# EasyEDA Pro project STM32G303的双FOC电机驱动.eprj, board axdr_v1.2 (continued)
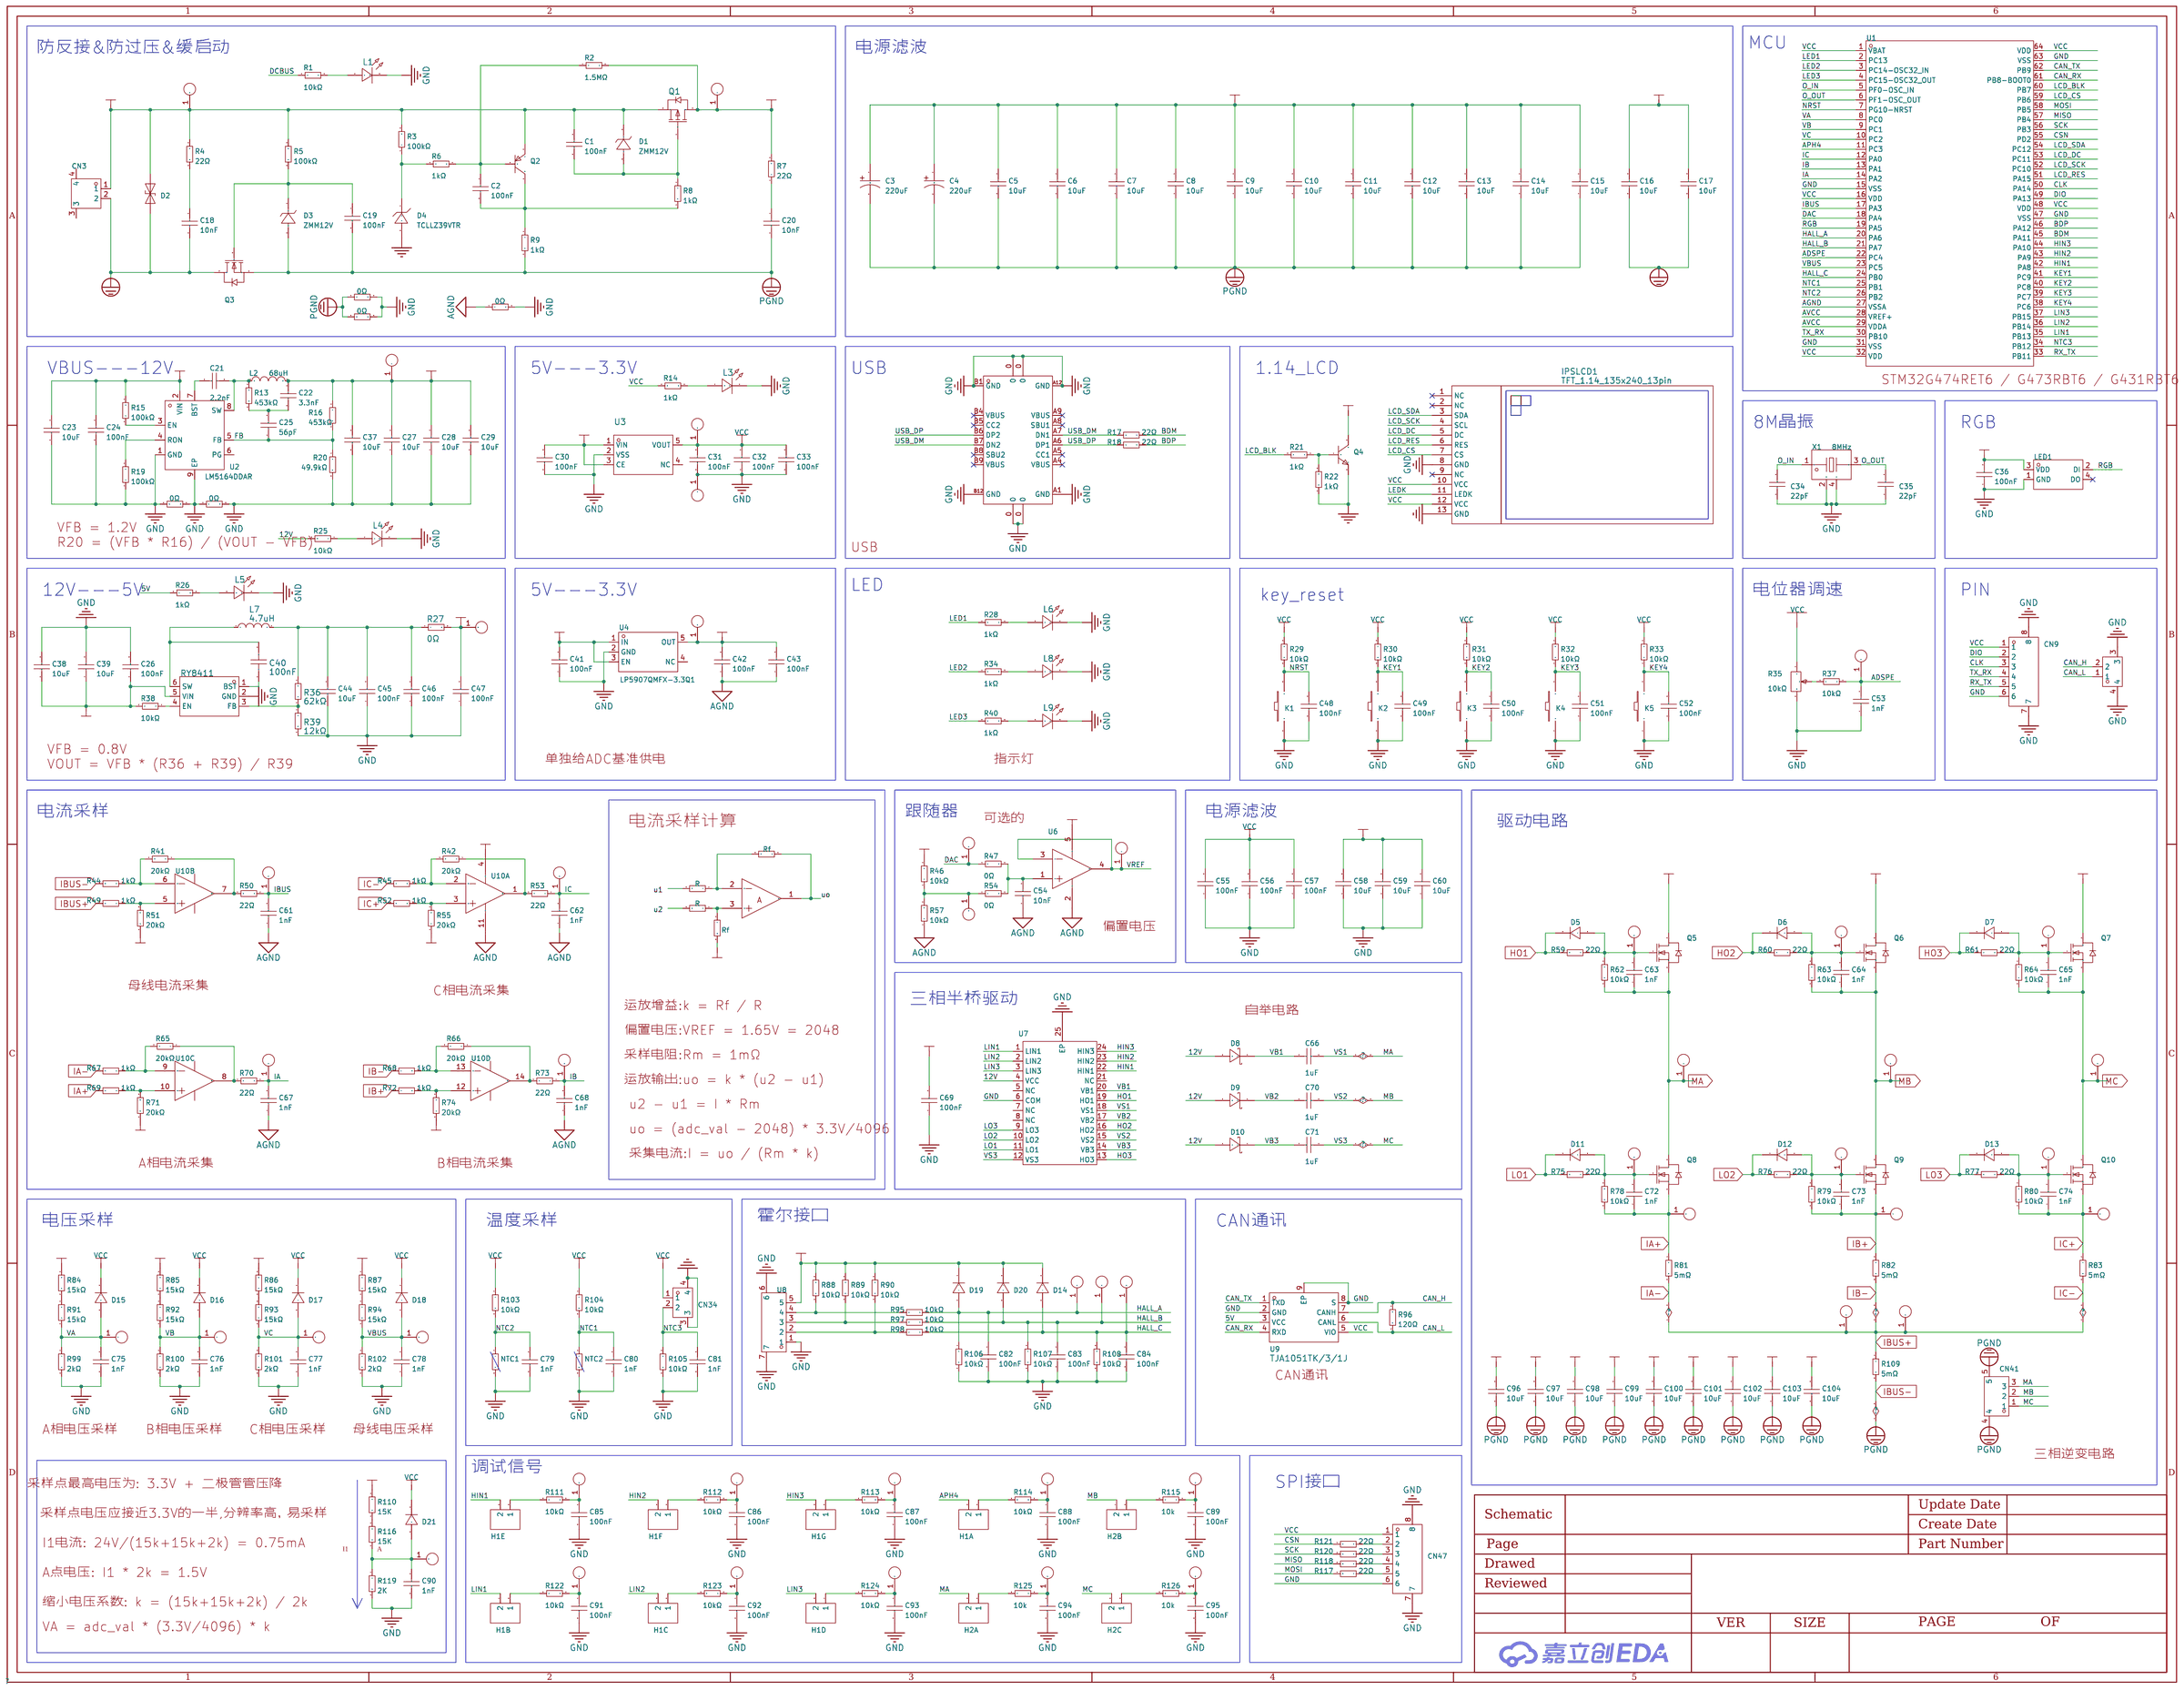
[diagram p0: schematic sheet]
## Routing (per net, layer and track width the routed paths; a pad name or vN(x,y) marks a point on that pad's centre or on a via; arc(x,y) is an arc through that point) (continued)
  内层4 w0.127: v1(71.21,23.83) 70.57,23.2 68.86,23.2 67.93,22.26 67.93,14.43 65.01,11.51 54.47,11.51 53.84,12.15 53.84,15.45 52.95,16.34 52.28,16.34 v1(52.28,16.33)
VB: length 47.6
  Top Layer w0.127: 77.86,27.9 77.57,27.61 77.57,26.5 77.57,26.5 v1(77.57,23.98) ; 77.86,27.9 79.4,27.9 CN38.1 ; 77.86,27.9 77.57,28.19 77.57,29.3 ; U1.9 v1(52.69,15.83)
  内层4 w0.127: v1(52.69,15.83) 53.01,15.83 53.52,15.32 53.52,12.02 54.28,11.26 65.12,11.26 68.19,14.33 68.19,22.16 68.97,22.94 76.82,22.94 77.57,23.69 v1(77.57,23.98)
VB1: length 5.2
  Top Layer w0.152: 44.18,28.66 44.69,28.15 44.69,26.63 45.08,26.23 U7.20
  Top Layer w0.254: C66.2 43.88,28.94 D8.1
VB2: length 8
  Top Layer w0.152: U7.17 47.06,28.2 46.72,28.53 45.92,28.53 45.26,29.19 45.26,31.39 44.99,31.66 D9.1
  Top Layer w0.254: D9.1 43.88,31.96 C70.2
VB3: length 12.3
  Top Layer w0.152: D10.1 45.4,34.68 45.96,34.12 45.96,29.67 46.41,29.23 47.93,29.23 48.56,28.6 U7.14
  Top Layer w0.254: D10.1 43.88,34.98 C71.2
VC: length 52.6
  Top Layer w0.127: 82.94,27.89 82.65,28.18 82.65,29.29 ; 82.94,27.89 82.65,27.6 82.65,26.36 ; 82.94,27.89 84.45,27.89 CN39.1 ; U1.10 v1(52.28,15.33) ; 82.65,26.36 82.65,26.37 ; 82.65,26.36 v1(82.65,23.84)
  内层4 w0.127: v1(82.65,23.84) 78.1,23.84 76.95,22.69 69.08,22.69 68.44,22.05 68.44,14.22 65.22,11 54.03,11 53.26,11.77 53.26,15.07 53.01,15.32 52.29,15.32 v1(52.28,15.33)
VREF: length 61.2
  Top Layer w0.127: CN13.1 65.07,0.97 65.84,1.73 65.84,4.84 65.3,5.39 U6.3
  Top Layer w0.203: R71.1 v1(82.16,20.59) ; R74.1 70.09,23.38 v1(70.09,23.83) ; v1(64.12,8.02) 63.44,8.02 U6.4 U6.3 ; R51.1 77.26,10.99 v1(77.39,10.86) ; 67.31,14.31 67.31,12.65 v1(67.42,12.53)
  Inner2 w0.203: v1(67.42,12.53) 67.81,12.15 76.95,12.15 77.39,11.71 v1(77.39,10.86)
  内层3 w0.203: v1(70.09,23.83) 70.09,22.43 70.73,21.8 78.73,21.8 79.93,20.59 80.89,20.59 ; v1(77.39,10.86) 80.62,10.86 80.89,11.13 80.89,20.59 ; v1(67.42,12.53) 67.11,12.53 65.14,10.56 65.14,8.46 64.69,8.02 v1(64.12,8.02) ; v1(82.16,20.59) 80.89,20.59
$1N7256: length 1.5
  Top Layer w0.254: C18.1 19.3,44.22
$1N10553: length 4
  Top Layer w0.254: Q2.1 21.02,51.39 C2.1 19.92,51.4 17.39,51.4
$1N11589: length 4.9
  Top Layer w0.254: R5.1 23.85,42.87 D3.1 23.48,42.75 21.8,42.75
  Bottom Layer w0.152: C19.1 v1(23.86,44.22)
$1N11866: length 3.8
  Top Layer w0.254: R6.2 17.38,52.91 16.11,52.91 ; 16.11,52.91 R3.1 ; 16.11,52.91 14.85,52.91 14.49,53.27 14.49,54.06
$1N12961: length 1.3
  Top Layer w0.254: C20.1 R7.1
$1N15998: length 8.7
  Top Layer w0.254: R9.1 27.04,52.66 25.78,51.4 25.77,51.4 25.02,52.15 23.21,52.15 Q2.3 21.96,52.9 C2.2
$1N55849: length 28.3
  Top Layer w0.254: CN17.1 59.42,48.34 57.01,48.34 ; 56.38,49.88 55.24,49.88 54.72,49.36 54.72,33.99 54.09,33.36 49.56,33.36 48.06,31.85 R59.1
$1N56388: length 36.1
  Top Layer w0.254: 55.74,27.63 56.99,27.63 57.76,28.4 59.04,28.4 60.06,29.42 60.06,32.47 60.82,33.23 67.23,33.23 67.81,33.8 67.81,49.23 68.45,49.88 69.46,49.88 ; Q8.1 72.38,48.34 CN25.1
$1N57486: length 18.5
  Top Layer w0.254: CN18.1 59.42,41.35 57.01,41.35 ; R63.1 55.62,42.89 55.23,42.5 55.23,33.86 54.22,32.85 52.13,32.85 51.13,31.85 49.9,31.85
$1N57488: length 27.1
  Top Layer w0.254: CN26.1 72.38,41.35 70.09,41.35 ; R76.1 60.02,27.5 D12.2 60.57,28.05 60.57,32.21 61.07,32.72 67.55,32.72 68.31,33.48 68.31,42.64 68.57,42.89 R79.1
$1N58344: length 8.6
  Top Layer w0.203: D7.2 54.11,31.85 52.88,31.85
  Top Layer w0.254: R64.1 56.38,34.12 D7.2 ; CN19.1 59.42,34.37 57.01,34.37
$1N58346: length 14.6
  Top Layer w0.254: CN27.1 72.38,34.37 Q10.1 70.09,34.36 v1(70.09,33.23) ; R77.1 63.07,27.5 D13.2 v1(63.36,28.28)
  Inner2 w0.254: v1(70.09,33.23) 70.09,32.72 65.65,28.28 v1(63.36,28.28)
$1N74659: length 5.9
  Top Layer w0.127: R55.2 R52.2 69.33,15.58 69.58,15.83 69.58,17.61 69.98,18 71.36,18
$1N75153: length 4
  Top Layer w0.127: U10.2 69.35,18.66 R42.2 R45.2
$1N75339: length 4.6
  Top Layer w0.127: U10.1 71.28,19.39 R53.2 67.53,18.12 67.31,18.12
$1N78360: length 4.4
  Top Layer w0.127: R41.1 73.45,12.51 72.31,13.65 ; R50.2 72.18,15.2 71.98,15.4 U10.7
$1N78363: length 8
  Top Layer w0.127: U10.5 74.42,16.7 75.17,15.96 75.17,14.56 75.99,13.74 R49.2 R51.2
$1N78364: length 6.6
  Top Layer w0.127: 71.36,16.05 74.25,16.05 74.72,15.58 R44.2 74.72,13.65 73.58,13.65
$1N79721: length 4.6
  Top Layer w0.127: 76.96,19.3 76.25,19.3 76,19.55 R73.2 74.72,22.32 R66.1
$1N79723: length 7.8
  Top Layer w0.127: 76.96,18 75.79,18 74.28,19.51 72.89,19.51 72.19,20.21 R72.2 R74.2
$1N79724: length 5.4
  Top Layer w0.127: 76.96,18.66 76.93,18.62 75.68,18.62 74.72,19.58 R66.2 R68.2
$1N80505: length 4.5
  Top Layer w0.127: 76.96,15.4 79.26,15.4 R70.2 80.64,16.78 R65.1
$1N80507: length 6
  Top Layer w0.127: R71.2 R69.2 78.66,19.32 78.35,19.01 78.35,16.97 78.08,16.7 76.96,16.7
$1N80508: length 4
  Top Layer w0.127: 76.96,16.05 78.64,16.05 R65.2 R67.2
$1N96819: length 2
  Top Layer w0.127: 71.12,29.31 72.39,30.57 R84.2
$1N96824: length 2
  Top Layer w0.127: R85.2 77.34,30.57 76.07,29.3
$1N96829: length 2
  Top Layer w0.127: 67.67,30.56 67.42,30.56 66.16,29.3 66.16,29.29
$1N96834: length 2
  Top Layer w0.127: 82.65,30.56 82.42,30.56 81.15,29.29
$1N107842: length 7.8
  Top Layer w0.127: R95.1 89.33,18.11 R88.2 91.83,15.61 U8.4
$1N108105: length 7.1
  Top Layer w0.127: 94.81,14.36 91.88,14.36 91.05,15.2 89.34,15.2 R89.2 88.07,15.19 R97.1
$1N108370: length 7.1
  Top Layer w0.127: R90.2 91.04,12.27 91.88,13.11 U8.2 ; 89.33,12.26 R98.1
$1N130103: length 1.3
  Top Layer w0.254: R40.1 36.57,36.37 35.31,36.37
$1N130414: length 3.8
  内层3 w0.254: v1(34.04,36.37) 37.84,36.37 v1(37.85,36.36)
$1N134680: length 1.3
  Top Layer w0.254: L5.1 12.31,11.64
$1N145652: length 7
  Top Layer w0.127: CN47.5 94.78,26.88 R117.1
$1N145656: length 7
  Top Layer w0.127: R118.1 87.86,25.6 CN47.4
$1N145660: length 7
  Top Layer w0.127: CN47.3 87.86,24.35 R120.1
$1N145664: length 7
  Top Layer w0.127: CN47.2 87.88,23.1 R121.1
$1N245778: length 2.7
  Top Layer w0.254: U5.3 17.49,28.34 R36.2 R39.1
$1N245779: length 3.6
  Top Layer w0.203: L7.1 12.67,30.57 C40.2 13.5,30.49 U5.6
$1N245780: length 1.7
  Top Layer w0.203: C40.1 13.5,28.98 U5.1
$1N268846: length 1.3
  Top Layer w0.127: 5.58,21.8 5.58,23.07
$1N269486: length 2.3
  Top Layer w0.152: 39.12,31.21 39.12,31.44 37.85,32.71 37.85,33.02
$1N270139: length 2.8
  Top Layer w0.127: 77.52,2.51 77.52,2.5 CN42.1 ; 77.52,2.51 C85.1 ; 77.52,2.51 R111.1
$1N270143: length 2.4
  Top Layer w0.127: 77.52,6.18 77.52,4.63 R111.2
$1N270253: length 2.8
  Top Layer w0.127: 70.56,2.5 70.55,2.51 69.91,2.51 ; CN49.1 69.91,0.98 69.91,2.51 ; 69.91,2.51 R122.1
$1N270255: length 2.4
  Top Layer w0.127: R122.2 69.9,4.63 69.9,6.18
$1N270473: length 2.8
  Top Layer w0.127: 80.07,2.51 80.06,2.49 CN43.1 ; 80.07,2.51 R112.1 ; 80.07,2.51 C86.1
$1N270475: length 2.4
  Top Layer w0.127: R112.2 80.06,4.63 80.06,6.18
$1N270480: length 2.8
  Top Layer w0.127: R123.1 C92.1 ; CN50.1 72.44,2.5
$1N270482: length 2.4
  Top Layer w0.127: R123.2 72.44,4.63 72.44,6.18
$1N270701: length 2.8
  Top Layer w0.127: 82.6,2.51 82.6,2.5 CN44.1 ; 82.6,2.51 R113.1 ; 82.6,2.51 C87.1
$1N270703: length 2.4
  Top Layer w0.127: R113.2 82.6,4.63 82.6,6.18
$1N270708: length 2.8
  Top Layer w0.127: R124.1 74.97,2.51 ; 74.97,2.51 C93.1 ; 74.97,2.51 74.98,2.5 CN51.1
$1N270710: length 2.4
  Top Layer w0.127: R124.2 74.98,4.63 74.98,6.18
$1N398404: length 17.4
  Top Layer w0.254: Q1.1 16.75,45.68 v1(16.62,45.8) ; 25.77,52.91 25.76,52.9 C1.2 24.48,52.91 v1(23.48,52.91)
  Inner2 w0.254: v1(16.62,45.8) 16.62,49.87 17.13,50.37 22.97,50.37 23.48,50.88 v1(23.48,52.91)
$1N441583: length 2.8
  Top Layer w0.127: 67.35,2.51 C88.1 ; 67.35,2.51 R114.1 ; 67.35,2.51 67.36,2.5 67.36,0.97
$1N441584: length 2.4
  Top Layer w0.127: 67.36,6.18 67.36,4.63 R114.2
$1N704042: length 6.8
  内层3 w0.254: v1(39.12,36.36) 38.52,35.77 33.36,35.77 v1(32.77,36.37)
$1N752227: length 6.1
  Top Layer w0.127: R54.1 61.19,1.62 61.84,0.97 CN16.1 63.04,0.97 63.74,1.67 63.74,2.49 R57.2
  Top Layer w0.152: 65,2.5 R57.2
$1N807322: length 6.8
  Top Layer w0.152: R35.2 92.25,7.7 93.33,6.62 95.73,6.62 R37.2
$1N846235: length 2.1
  Top Layer w0.203: U5.4 16.05,31.38 16.31,31.64 17,31.64 17.53,32.17
$1N858763: length 4.3
  Top Layer w0.127: U6.1 61.51,5.17 62.46,4.22 C54.2 R54.2 R47.2
$1N920711: length 3.3
  Top Layer w0.127: R21.1 47.42,8.09 Q4.1 47.19,9.61 R22.1
$1N958663: length 15.9
  Top Layer w0.254: v1(17.53,25.67) R36.1
  Top Layer w0.508: R27.1 8.95,30.61 v1(8.94,30.61)
  Inner2 w0.254: v1(17.53,25.67) 16.95,25.1 v1(14.02,25.1)
  内层3 w0.508: v1(14.02,25.1) v1(13.39,25.1) 11.61,25.1 8.94,27.77 v1(8.94,30.61) v1(8.94,31.2)
$1N1062496: length 1.3
  Top Layer w0.203: 16.26,36.37 17.53,36.37
$1N1062500: length 2.1
  Top Layer w0.254: 34.75,31.13 34.75,32.45 R19.1
$1N1062505: length 2.6
  Top Layer w0.203: C25.2 C22.2 R13.2
$1N1062507: length 4.1
  Top Layer w0.254: R15.2 35.74,32.18 35.74,30.49 35.11,29.86 34.75,29.86
$1N1062508: length 1.7
  Top Layer w0.508: U2.7 27.23,28.59 C21.1

## Copper pours and planes (outline as drawn; the poured copper is in the pictures)
12V on Top Layer: 14.78,30.63 14.85,30.56 15.35,30.56 15.42,30.63 15.42,31.83 15.54,31.96 16.62,31.96 16.69,32.02 16.69,32.85 16.81,32.98 18.59,32.98 18.72,32.85 18.72,31.45 24.69,31.45 24.69,34.31 24.75,34.37 28.12,34.37 28.18,34.44 28.18,35.26 28.12,35.33 17.13,35.33 17.01,35.2 17.01,34.18 16.88,34.05 15.86,34.05 15.75,33.94 15.75,33.04 14.78,32.07
AGND on 内层3: 68.34,21.42 79.87,21.42 79.87,13.29 68.34,13.29
GND on Top Layer: 0,55 0,0 83.81,0 83.81,-2.71 85.08,-2.71 85.08,0 100,0 100,55.02
GND on Bottom Layer: 0,55 0,0 81.05,0 81.05,-2.71 82.69,-2.71 82.69,0 100,0 100,55
GND on Inner1: 0,55 0,0 88.47,0 88.47,-2.71 90.04,-2.71 90.04,0 100,0 100,55
GND on Inner2: 0,55 0,0 91.39,0 91.39,-2.71 92.46,-2.71 92.46,0 100,0 100,55
GND on 内层3: 0,55 0,0 93.29,0 93.29,-2.71 94.36,-2.71 94.36,0 100,0 100,55
GND on 内层4: 0,55 0,0 86.18,0 86.18,-2.71 87.25,-2.71 87.25,0 100,0 100,55
PGND on Top Layer: 29.77,37.99 31.99,37.99 31.99,35.96 29.77,35.96
PGND on Top Layer: 88.25,35.07 88.32,35.01 89.46,35.01 89.52,34.94 89.52,31.45 89.4,31.32 85.01,31.32 84.82,31.13 84.82,29.23 85.08,28.97 92.32,28.97 92.44,29.1 92.44,36.21 93.18,36.95 100,36.95 100,55 83.93,55 83.93,49.1 84.12,48.91 87.95,48.91 88.25,48.61
PGND on Top Layer: 46.98,43.9 46.98,37.29 21.2,37.29 21.2,41.87 24.63,41.87 24.75,41.99 24.75,42.64 26.03,42.64 26.15,42.75 26.15,43.77 26.28,43.9
PGND on Bottom Layer: 88.27,32.72 88.52,32.98 88.52,55.01 92.44,55.01 100,55 100,36.63 92.86,36.63 92.44,36.21 92.44,28.91 42.43,28.93 42.17,29.18 42.17,37.15 42.02,37.29 24.88,37.29 24.63,37.55 24.63,43.77 24.75,43.9 46.98,43.9 46.98,32.98 47.23,32.72 57.31,32.72 57.67,33.09 57.67,53.42 59.42,53.42 59.42,33.1 59.8,32.72
PGND on Inner1: 92.44,28.91 42.43,28.93 42.17,29.18 42.17,37.15 42.02,37.29 24.88,37.29 24.63,37.55 24.63,43.77 24.75,43.9 46.98,43.9 46.98,32.98 47.23,32.72 88.27,32.72 88.52,32.98 88.52,55.01 92.44,55.01 100,55 100,36.63 92.86,36.63 92.44,36.21
PGND on Inner2: 88.26,55 88.26,29.16 88.44,28.97 92.32,28.97 92.44,29.1 92.44,36.21 92.86,36.63 100,36.63 100,55
PGND on 内层3: 92.44,28.91 42.43,28.93 42.17,29.18 42.17,37.15 42.02,37.29 24.88,37.29 24.63,37.55 24.63,43.77 24.75,43.9 46.98,43.9 46.98,32.98 47.23,32.72 88.27,32.72 88.52,32.98 88.52,55.01 92.44,55.01 100,55 100,36.63 92.86,36.63 92.44,36.21
PGND on 内层4: 92.44,28.91 42.43,28.93 42.17,29.18 42.17,37.15 42.02,37.29 24.88,37.29 24.63,37.55 24.63,43.77 24.75,43.9 46.98,43.9 46.98,32.98 47.23,32.72 88.27,32.72 88.52,32.98 88.52,55.01 92.44,55.01 100,55 100,36.63 92.86,36.63 92.44,36.21
PGND_IN on Top Layer: 0.24,43.9 0.37,44.02 15.61,44.02 15.74,44.15 15.74,44.79 16.75,44.79 16.75,43.52 16.88,43.39 20.69,43.39 20.69,38.56 8.12,38.56 7.99,38.69 7.99,39.13 7.92,39.2 0.37,39.2 0.24,39.33
PGND_IN on Bottom Layer: 0.24,43.9 0.37,44.02 15.61,44.02 15.67,43.79 16.78,43.79 16.75,43.52 16.88,43.39 20.69,43.39 20.69,38.56 8.12,38.56 7.99,38.69 7.99,39.13 7.92,39.2 0.37,39.2 0.24,39.33
PGND_IN on Inner1: 0.24,43.89 0.37,44.01 15.35,44.01 15.48,43.89 15.48,39.31 15.35,39.19 0.37,39.19 0.24,39.31
PGND_IN on Inner2: 0.24,43.89 0.37,44.01 15.35,44.01 15.48,43.89 15.48,39.31 15.35,39.19 0.37,39.19 0.24,39.31
PGND_IN on 内层3: 0.24,43.89 0.37,44.01 15.35,44.01 15.48,43.89 15.48,39.31 15.35,39.19 0.37,39.19 0.24,39.31
PGND_IN on 内层4: 0.24,43.89 0.37,44.01 15.35,44.01 15.48,43.89 15.48,39.31 15.35,39.19 0.37,39.19 0.24,39.31
DCBUS on Top Layer: 37.13,29.34 37.06,29.42 36.82,29.42 35.99,28.66 35.99,30.24 36.12,30.37 36.12,31.9 38.35,31.9 38.35,30.87 38.53,30.69 40.75,30.69 40.88,30.56 40.88,28.34 40.82,28.28 37.2,28.28 37.13,28.34
DCBUS on Top Layer: 26.02,45.8 26.15,45.68 26.15,44.78 26.27,44.66 47.42,44.66 47.61,44.44 47.61,33.86 53.45,33.86 53.45,53.42 45.07,53.42 44.95,53.3 44.95,51.26 44.82,51.14 27.93,51.14 27.8,51.01 27.8,50.12 27.67,49.99 19.42,49.99 19.42,45.17 24.37,45.17 24.5,45.29 24.5,45.68 24.63,45.8
DCBUS on Bottom Layer: 26.02,45.17 26.15,45.04 26.15,44.78 26.27,44.66 47.42,44.66 47.61,44.44 47.61,33.86 56.38,33.86 56.38,53.42 45.07,53.42 44.95,53.3 44.95,51.26 44.82,51.14 24.75,51.14 24.63,51.01 24.63,50.18 24.43,49.99 19.42,49.99 19.42,45.17
DCBUS on Inner1: 24.75,51.14 24.63,51.01 24.63,44.79 24.75,44.66 47.36,44.66 47.61,44.4 47.61,33.86 53.45,33.86 53.45,53.42 47.62,53.42 47.62,51.27 47.49,51.14
DCBUS on Inner2: 33.39,51.14 44.63,51.14 44.82,50.95 44.82,44.91 44.56,44.66 42.34,44.66 42.02,44.34 42.02,37.48 41.01,36.47 41.01,28.47 40.82,28.28 36.31,28.28 36.12,28.47 36.12,33.8 36.44,34.12 39.48,34.12 39.61,34.25 39.61,44.28 39.23,44.66 33.52,44.66 33.2,44.98 33.2,50.95
DCBUS on 内层3: 24.75,51.14 24.63,51.01 24.63,44.79 24.75,44.66 47.36,44.66 47.61,44.4 47.61,33.86 53.45,33.86 53.45,53.42 47.62,53.42 47.62,51.27 47.49,51.14
DCBUS on 内层4: 24.75,51.14 24.63,51.01 24.63,44.79 24.75,44.66 47.36,44.66 47.61,44.4 47.61,33.86 53.45,33.86 53.45,53.42 47.62,53.42 47.62,51.27 47.49,51.14
DCBUS_IN on Top Layer: 0.37,49.36 15.23,49.36 15.86,49.99 19.04,49.99 19.04,46.56 15.61,46.56 15.48,46.44 15.48,44.66 15.35,44.53 0.37,44.53 0.24,44.66 0.24,49.23
DCBUS_IN on Bottom Layer: 0.24,49.23 0.37,49.36 15.35,49.36 15.48,49.23 15.48,44.66 15.35,44.53 0.37,44.53 0.24,44.66
DCBUS_IN on Inner1: 0.24,49.23 0.37,49.36 15.35,49.36 15.48,49.23 15.48,44.66 15.35,44.53 0.37,44.53 0.24,44.66
DCBUS_IN on Inner2: 0.24,49.23 0.37,49.36 15.35,49.36 15.48,49.23 15.48,44.66 15.35,44.53 0.37,44.53 0.24,44.66
DCBUS_IN on 内层3: 0.24,49.23 0.37,49.36 15.35,49.36 15.48,49.23 15.48,44.66 15.35,44.53 0.37,44.53 0.24,44.66
DCBUS_IN on 内层4: 0.24,49.23 0.37,49.36 15.35,49.36 15.48,49.23 15.48,44.66 15.35,44.53 0.37,44.53 0.24,44.66
IA+ on Top Layer: 68.82,53.68 74.79,53.68 74.92,53.55 74.92,48.85 73.65,48.85 73.52,48.98 73.52,49.23 73.39,49.36 71.87,49.36 71.74,49.49 71.74,50.76 71.62,50.88 68.82,50.88
IA- on Top Layer: 79.74,54.82 83.68,54.82 83.68,36.02 83.81,35.9 84.57,35.9 84.7,35.77 84.7,31.45 79.74,31.45
IB+ on Top Layer: 68.82,46.69 74.79,46.69 74.92,46.56 74.92,41.87 73.65,41.87 73.52,41.99 73.52,42.25 73.39,42.37 71.87,42.37 71.74,42.5 71.74,43.77 71.62,43.9 68.82,43.9
IC+ on Top Layer: 68.82,39.71 74.79,39.71 74.92,39.58 74.92,34.88 73.65,34.88 73.52,35.01 73.52,35.26 73.39,35.39 71.87,35.39 71.74,35.52 71.74,36.79 71.62,36.91 68.82,36.91
MA on Top Layer: 55.74,53.68 66.54,53.68 66.54,47.83 60.69,47.83 60.69,49.1 60.57,49.23 58.79,49.23 58.66,49.36 58.66,50.76 58.53,50.88 55.74,50.88
MA on Bottom Layer: 60.69,53.42 84.7,53.42 87.36,50.76 87.36,45.8 87.24,45.68 84.44,45.68 82.28,47.83 60.69,47.83
MA on Inner1: 60.69,53.42 84.7,53.42 87.36,50.76 87.36,45.8 87.24,45.68 84.44,45.68 82.28,47.83 60.69,47.83
MA on Inner2: 55.74,53.68 66.54,53.68 66.54,47.84 55.74,47.84
MA on 内层3: 60.69,53.42 84.7,53.42 87.36,50.76 87.36,45.8 87.24,45.68 84.44,45.68 82.28,47.83 60.69,47.83
MA on 内层4: 60.69,53.42 84.7,53.42 87.36,50.76 87.36,45.8 87.24,45.68 84.44,45.68 82.28,47.83 60.69,47.83
MB on Top Layer: 55.74,46.69 66.54,46.69 66.54,40.85 60.69,40.85 60.69,42.12 60.57,42.25 58.79,42.25 58.66,42.37 58.66,43.77 58.53,43.9 55.74,43.9
MB on Bottom Layer: 60.69,46.44 82.41,46.44 83.68,45.17 87.11,45.17 87.36,44.91 87.36,42.37 87.11,42.12 83.68,42.12 82.41,40.85 60.69,40.85
MB on Inner1: 60.69,46.44 82.41,46.44 83.68,45.17 87.11,45.17 87.36,44.91 87.36,42.37 87.11,42.12 83.68,42.12 82.41,40.85 60.69,40.85
MB on Inner2: 55.74,46.69 66.54,46.69 66.54,40.86 55.74,40.86
MB on 内层3: 60.69,46.44 82.41,46.44 83.68,45.17 87.11,45.17 87.36,44.91 87.36,42.37 87.11,42.12 83.68,42.12 82.41,40.85 60.69,40.85
MB on 内层4: 60.69,46.44 82.41,46.44 83.68,45.17 87.11,45.17 87.36,44.91 87.36,42.37 87.11,42.12 83.68,42.12 82.41,40.85 60.69,40.85
MC on Top Layer: 55.74,39.71 66.54,39.71 66.54,33.86 60.69,33.86 60.69,35.13 60.57,35.26 58.79,35.26 58.66,35.39 58.66,36.79 58.53,36.91 55.74,36.91
MC on Bottom Layer: 60.69,39.58 60.69,33.86 84.82,33.86 87.36,36.4 87.36,41.36 87.11,41.61 84.32,41.61 82.28,39.58
MC on Inner1: 60.69,39.58 60.69,33.86 84.82,33.86 87.36,36.4 87.36,41.36 87.11,41.61 84.32,41.61 82.28,39.58
MC on Inner2: 55.74,39.71 66.54,39.71 66.54,33.87 55.74,33.87
MC on 内层3: 60.69,39.58 60.69,33.86 84.82,33.86 87.36,36.4 87.36,41.36 87.11,41.61 84.32,41.61 82.28,39.58
MC on 内层4: 60.69,39.58 60.69,33.86 84.82,33.86 87.36,36.4 87.36,41.36 87.11,41.61 84.32,41.61 82.28,39.58
$1N55849 on Top Layer: 55.74,50.37 58.28,50.37 58.28,47.83 55.74,47.83
$1N56388 on Top Layer: 68.82,50.37 71.36,50.37 71.36,47.83 68.82,47.83
$1N57486 on Top Layer: 55.74,43.39 58.28,43.39 58.28,40.85 55.74,40.85
$1N57488 on Top Layer: 68.82,43.39 71.36,43.39 71.36,40.85 68.82,40.85
$1N58344 on Top Layer: 55.74,36.4 58.28,36.4 58.28,33.82 55.74,33.82
$1N58346 on Top Layer: 68.82,36.4 71.36,36.4 71.36,33.86 68.82,33.86
$1N958663 on Top Layer: 9.83,29.17 9.77,29.1 9.77,27.9 9.83,27.83 10.97,27.83 11.86,26.94 11.86,24.72 11.93,24.66 14.66,24.66 14.78,24.78 14.78,27.39 14.72,27.45 13.13,27.45 12.05,28.53 12.05,29.17
$1N1062506 on Top Layer: 24.69,28.72 24.69,27.7 24.75,27.64 29.58,27.64 29.58,26.5 18.72,26.5 18.72,28.72

Small or netless copper shapes (teardrops, artwork), in the pictures only: 905 on Top Layer, 6 on Bottom Layer, 1 on Inner1, 99 on Inner2, 82 on 内层3, 76 on 内层4

## Text on the board
Bottom Silkscreen Layer: Ver 1.2 Designed by | High Performance | [ Single Channel ] | PMSM/BLDC Driver | [Field Oriented Control] | Inside | Algorithm | disnox | [ AxDriver-L ]
Top Solder Mask Layer: [Ver1.2]
Top Silkscreen Layer: R | H | D | L | C | T | V | H4 | L1 | L2 | L3 | H1 | H2 | H3 | G | GND | SDI | SDO | SCK | CSN | VCC | 5V | U | W | VIN | AVCC | 12V | NTC | VBUS | DAC | Vref | USB | IC | A | B | IS | VI | VA | VB | IB | VC | IA | disnox | AxDr-L | NRST | KEY1 | KEY2 | KEY3 | KEY4 | SPI | HALL | SWD | CAN | LCD | 12~48V | JLCJLCJLCJLC
